# EAGLE schematic BMS-HVver2.0 (EAGLE 7.6.0) (continued)
## Parts (continued)
Q19  BSS308PE  BSS308PEBSS308PE  [SOT23]
Q20  BSS308PE  BSS308PEBSS308PE  [SOT23]
Q21  BSS308PE  BSS308PEBSS308PE  [SOT23]
Q22  BSS308PE  BSS308PEBSS308PE  [SOT23]
Q23  BSS308PE  BSS308PEBSS308PE  [SOT23]
Q24  BSS308PE  BSS308PEBSS308PE  [SOT23]
Q25  BSS308PE  BSS308PEBSS308PE  [SOT23]
Q26  BSS308PE  BSS308PEBSS308PE  [SOT23]
Q27  BSS308PE  BSS308PEBSS308PE  [SOT23]
Q28  BSS308PE  BSS308PEBSS308PE  [SOT23]
Q29  BSS308PE  BSS308PEBSS308PE  [SOT23]
Q30  BSS308PE  BSS308PEBSS308PE  [SOT23]
Q31  BSS308PE  BSS308PEBSS308PE  [SOT23]
Q32  BSS308PE  BSS308PEBSS308PE  [SOT23]
Q33  BSS308PE  BSS308PEBSS308PE  [SOT23]
Q34  BSS308PE  BSS308PEBSS308PE  [SOT23]
Q35  BSS308PE  BSS308PEBSS308PE  [SOT23]
Q36  BSS308PE  BSS308PEBSS308PE  [SOT23]
Q37  BSS308PE  BSS308PEBSS308PE  [SOT23]
Q38  BSS308PE  BSS308PEBSS308PE  [SOT23]
Q39  BSS308PE  BSS308PEBSS308PE  [SOT23]
R2  100  RES_100_1%  [0603]
R3  100  RES_100_1%  [0603]
R4  100  RES_100_1%  [0603]
R5  100  RES_100_1%  [0603]
R6  100  RES_100_1%  [0603]
R7  3.3K  RES_3.3K_5%  [0603]
R8  3.3K  RES_3.3K_5%  [0603]
R9  475  RES_475_1%  [0603]
R10  475  RES_475_1%  [0603]
R11  100  RES_100_1%  [0603]
R12  3.3K  RES_3.3K_5%  [0603]
R13  475  RES_475_1%  [0603]
R14  100  RES_100_1%  [0603]
R15  3.3K  RES_3.3K_5%  [0603]
R16  475  RES_475_1%  [0603]
R17  100  RES_100_1%  [0603]
R18  3.3K  RES_3.3K_5%  [0603]
R19  475  RES_475_1%  [0603]
R20  100  RES_100_1%  [0603]
R21  3.3K  RES_3.3K_5%  [0603]
R22  475  RES_475_1%  [0603]
R23  100  RES_100_1%  [0603]
R24  3.3K  RES_3.3K_5%  [0603]
R25  475  RES_475_1%  [0603]
R26  100  RES_100_1%  [0603]
R27  3.3K  RES_3.3K_5%  [0603]
R28  475  RES_475_1%  [0603]
R29  100  RES_100_1%  [0603]
R30  3.3K  RES_3.3K_5%  [0603]
R31  475  RES_475_1%  [0603]
R32  100  RES_100_0.1%_0805  [0805]
R33  3.3K  RES_3.3K_1%_0805  [0805]
R34  475  RES_475_1%  [0603]
R35  100  RES_100_1%  [0603]
R36  3.3K  RES_3.3K_5%  [0603]
R37  475  RES_475_1%  [0603]
R38  100  RES_100_0.1%_0805  [0805]
R39  3.3K  RES_3.3K_1%_0805  [0805]
R40  475  RES_475_1%  [0603]
R41  0  RES_0_0805  [0805]
R42  16  RES_16_5%_TH  [RR02J16RTB]
R43  16  RES_16_5%_TH  [RR02J16RTB]
R44  16  RES_16_5%_TH  [RR02J16RTB]
R45  16  RES_16_5%_TH  [RR02J16RTB]
R46  16  RES_16_5%_TH  [RR02J16RTB]
R47  16  RES_16_5%_TH  [RR02J16RTB]
R48  16  RES_16_5%_TH  [RR02J16RTB]
R49  16  RES_16_5%_TH  [RR02J16RTB]
R50  16  RES_16_5%_TH  [RR02J16RTB]
R51  16  RES_16_5%_TH  [RR02J16RTB]
R52  16  RES_16_5%_TH  [RR02J16RTB]
R53  16  RES_16_5%_TH  [RR02J16RTB]
R54  16  RES_16_5%_TH  [RR02J16RTB]
R55  16  RES_16_5%_TH  [RR02J16RTB]
R56  16  RES_16_5%_TH  [RR02J16RTB]
R57  16  RES_16_5%_TH  [RR02J16RTB]
R58  16  RES_16_5%_TH  [RR02J16RTB]
R59  16  RES_16_5%_TH  [RR02J16RTB]
R60  16  RES_16_5%_TH  [RR02J16RTB]
R61  16  RES_16_5%_TH  [RR02J16RTB]
R62  16  RES_16_5%_TH  [RR02J16RTB]
R63  16  RES_16_5%_TH  [RR02J16RTB]
R64  16  RES_16_5%_TH  [RR02J16RTB]
R65  16  RES_16_5%_TH  [RR02J16RTB]
R66  1K  RES_1K_5%  [0603]
R67  10K  RN-4_10K  [MNR14]
R68  100K  RES_100K_5%  [0603]
R69  1.2K  RES_1.2K_5%  [0603]
R70  787  RES_787_1%  [0805]
R71  10K-NTC  RES_10K_NTC  [NTC-NXRT15XH103FA5B]
R72  10K-NTC  RES_10K_NTC  [NTC-NXRT15XH103FA5B]
R73  10K-NTC  RES_10K_NTC  [NTC-NXRT15XH103FA5B]
R74  100  RES_100_1%  [0603]
R75  100  RES_100_0.1%_0805  [0805]
R76  100  RES_100_0.1%_0805  [0805]
R77  100  RES_100_1%  [0603]
R78  100  RES_100_1%  [0603]
R79  3.3K  RES_3.3K_1%_0805  [0805]
R80  3.3K  RES_3.3K_5%  [0603]
R81  475  RES_475_1%  [0603]
R82  475  RES_475_1%  [0603]
R83  100  RES_100_1%  [0603]
R84  3.3K  RES_3.3K_1%_0805  [0805]
R85  475  RES_475_1%  [0603]
R86  100  RES_100_1%  [0603]
R87  3.3K  RES_3.3K_5%  [0603]
R88  475  RES_475_1%  [0603]
R89  100  RES_100_1%  [0603]
R90  3.3K  RES_3.3K_5%  [0603]
R91  475  RES_475_1%  [0603]
R92  100  RES_100_1%  [0603]
R93  3.3K  RES_3.3K_5%  [0603]
R94  475  RES_475_1%  [0603]
R95  100  RES_100_1%  [0603]
R96  3.3K  RES_3.3K_5%  [0603]
R97  475  RES_475_1%  [0603]
R98  100  RES_100_1%  [0603]
R99  3.3K  RES_3.3K_5%  [0603]
R100  475  RES_475_1%  [0603]
R101  100  RES_100_1%  [0603]
R102  3.3K  RES_3.3K_5%  [0603]
R103  475  RES_475_1%  [0603]
R104  100  RES_100_0.1%_0805  [0805]
R105  3.3K  RES_3.3K_1%_0805  [0805]
R106  475  RES_475_1%  [0603]
R107  100  RES_100_1%  [0603]
R108  3.3K  RES_3.3K_5%  [0603]
R109  475  RES_475_1%  [0603]
R110  100  RES_100_1%  [0603]
R111  3.3K  RES_3.3K_5%  [0603]
R112  475  RES_475_1%  [0603]
R113  0  RES_0_1%  [0603]
R114  16  RES_16_5%_TH  [RR02J16RTB]
R115  16  RES_16_5%_TH  [RR02J16RTB]
R116  16  RES_16_5%_TH  [RR02J16RTB]
R117  16  RES_16_5%_TH  [RR02J16RTB]
R118  16  RES_16_5%_TH  [RR02J16RTB]
R119  16  RES_16_5%_TH  [RR02J16RTB]
R120  16  RES_16_5%_TH  [RR02J16RTB]
R121  16  RES_16_5%_TH  [RR02J16RTB]
R122  16  RES_16_5%_TH  [RR02J16RTB]
R123  16  RES_16_5%_TH  [RR02J16RTB]
R124  16  RES_16_5%_TH  [RR02J16RTB]
R125  16  RES_16_5%_TH  [RR02J16RTB]
R126  16  RES_16_5%_TH  [RR02J16RTB]
R127  16  RES_16_5%_TH  [RR02J16RTB]
R128  16  RES_16_5%_TH  [RR02J16RTB]
R129  16  RES_16_5%_TH  [RR02J16RTB]
R130  16  RES_16_5%_TH  [RR02J16RTB]
R131  16  RES_16_5%_TH  [RR02J16RTB]
R132  16  RES_16_5%_TH  [RR02J16RTB]
R133  16  RES_16_5%_TH  [RR02J16RTB]
R134  16  RES_16_5%_TH  [RR02J16RTB]
R135  16  RES_16_5%_TH  [RR02J16RTB]
R136  16  RES_16_5%_TH  [RR02J16RTB]
R137  16  RES_16_5%_TH  [RR02J16RTB]
R138  1K  RES_1K_5%  [0603]
R139  10K  RN-4_10K  [MNR14]
R140  100K  RES_100K_5%  [0603]
R141  1.2K  RES_1.2K_5%  [0603]
R142  787  RES_787_1%  [0805]
R143  10K-NTC  RES_10K_NTC  [NTC-NXRT15XH103FA5B]
R144  10K-NTC  RES_10K_NTC  [NTC-NXRT15XH103FA5B]
R145  10K-NTC  RES_10K_NTC  [NTC-NXRT15XH103FA5B]
R146  10K-NTC  RES_10K_NTC  [NTC-NXRT15XH103FA5B]
R147  10K-NTC  RES_10K_NTC  [NTC-NXRT15XH103FA5B]
R149  100  RES_100_1%  [0603]
R150  100  RES_100_1%  [0603]
R151  100  RES_100_1%  [0603]
R152  100  RES_100_1%  [0603]
R153  100  RES_100_0.1%_0805  [0805]
R154  3.3K  RES_3.3K_5%  [0603]
R155  3.3K  RES_3.3K_1%_0805  [0805]
R156  475  RES_475_1%  [0603]
R157  475  RES_475_1%  [0603]
R158  100  RES_100_1%  [0603]
R159  3.3K  RES_3.3K_5%  [0603]
R160  475  RES_475_1%  [0603]
R161  100  RES_100_1%  [0603]
R162  3.3K  RES_3.3K_1%_0805  [0805]
R163  475  RES_475_1%  [0603]
R164  100  RES_100_1%  [0603]
R165  3.3K  RES_3.3K_5%  [0603]
R166  475  RES_475_1%  [0603]
R167  100  RES_100_1%  [0603]
R168  3.3K  RES_3.3K_5%  [0603]
R169  475  RES_475_1%  [0603]
R170  100  RES_100_1%  [0603]
R171  3.3K  RES_3.3K_5%  [0603]
R172  475  RES_475_1%  [0603]
R173  100  RES_100_1%  [0603]
R174  3.3K  RES_3.3K_5%  [0603]
R175  475  RES_475_1%  [0603]
R176  100  RES_100_1%  [0603]
R177  3.3K  RES_3.3K_1%_0805  [0805]
R178  475  RES_475_1%  [0603]
R179  100  RES_100_1%  [0603]
R180  3.3K  RES_3.3K_5%  [0603]
R181  475  RES_475_1%  [0603]
R182  100  RES_100_0.1%_0805  [0805]
R183  3.3K  RES_3.3K_1%_0805  [0805]
R184  475  RES_475_1%  [0603]
R185  100  RES_100_1%  [0603]
R186  3.3K  RES_3.3K_1%_0805  [0805]
R187  475  RES_475_1%  [0603]
R188  0  RES_0_1%  [0603]
R189  16  RES_16_5%_TH  [RR02J16RTB]
R190  16  RES_16_5%_TH  [RR02J16RTB]
R191  16  RES_16_5%_TH  [RR02J16RTB]
R192  16  RES_16_5%_TH  [RR02J16RTB]
R193  16  RES_16_5%_TH  [RR02J16RTB]
R194  16  RES_16_5%_TH  [RR02J16RTB]
R195  16  RES_16_5%_TH  [RR02J16RTB]
R196  16  RES_16_5%_TH  [RR02J16RTB]
R197  16  RES_16_5%_TH  [RR02J16RTB]
R198  16  RES_16_5%_TH  [RR02J16RTB]
R199  16  RES_16_5%_TH  [RR02J16RTB]
R200  16  RES_16_5%_TH  [RR02J16RTB]
R201  16  RES_16_5%_TH  [RR02J16RTB]
R202  16  RES_16_5%_TH  [RR02J16RTB]
R203  16  RES_16_5%_TH  [RR02J16RTB]
R204  16  RES_16_5%_TH  [RR02J16RTB]
R205  16  RES_16_5%_TH  [RR02J16RTB]
R206  16  RES_16_5%_TH  [RR02J16RTB]
R207  16  RES_16_5%_TH  [RR02J16RTB]
R208  16  RES_16_5%_TH  [RR02J16RTB]
R209  16  RES_16_5%_TH  [RR02J16RTB]
R210  16  RES_16_5%_TH  [RR02J16RTB]
R211  16  RES_16_5%_TH  [RR02J16RTB]
R212  16  RES_16_5%_TH  [RR02J16RTB]
R213  1K  RES_1K_5%  [0603]
R214  10K  RN-4_10K  [MNR14]
R215  100K  RES_100K_5%  [0603]
R216  1.2K  RES_1.2K_5%  [0603]
R217  787  RES_787_1%  [0805]
R218  10K-NTC  RES_10K_NTC  [NTC-NXRT15XH103FA5B]
R219  10K-NTC  RES_10K_NTC  [NTC-NXRT15XH103FA5B]
R220  10K-NTC  RES_10K_NTC  [NTC-NXRT15XH103FA5B]
R221  10K-NTC  RES_10K_NTC  [NTC-NXRT15XH103FA5B]
SJ1  JUMPER-PAD-3-NOYES_SILK  [PAD-JUMPER-3-NO_YES_SILK]
SJ2  JUMPER-PAD-3-NOYES_SILK  [PAD-JUMPER-3-NO_YES_SILK]
SJ3  JUMPER-PAD-3-NOYES_SILK  [PAD-JUMPER-3-NO_YES_SILK]
SJ4  JUMPER-PAD-3-NOYES_SILK  [PAD-JUMPER-3-NO_YES_SILK]
SJ5  JUMPER-PAD-2-NOYES_SILK  [PAD-JUMPER-2-NO_YES_SILK]
SJ6  JUMPER-PAD-3-NOYES_SILK  [PAD-JUMPER-3-NO_YES_SILK]
SJ7  JUMPER-PAD-3-NOYES_SILK  [PAD-JUMPER-3-NO_YES_SILK]
SJ8  JUMPER-PAD-3-NOYES_SILK  [PAD-JUMPER-3-NO_YES_SILK]
SJ9  JUMPER-PAD-3-NOYES_SILK  [PAD-JUMPER-3-NO_YES_SILK]
SJ10  JUMPER-PAD-2-NOYES_SILK  [PAD-JUMPER-2-NO_YES_SILK]
SJ11  JUMPER-PAD-3-NOYES_SILK  [PAD-JUMPER-3-NO_YES_SILK]
SJ12  JUMPER-PAD-3-NOYES_SILK  [PAD-JUMPER-3-NO_YES_SILK]
SJ13  JUMPER-PAD-3-NOYES_SILK  [PAD-JUMPER-3-NO_YES_SILK]
SJ14  JUMPER-PAD-3-NOYES_SILK  [PAD-JUMPER-3-NO_YES_SILK]
SJ15  JUMPER-PAD-2-NOYES_SILK  [PAD-JUMPER-2-NO_YES_SILK]
TX1  PE-68386NLT  [PE-68386NLT]
TX2  PE-68386NLT  [PE-68386NLT]
TX3  PE-68386NLT  [PE-68386NLT]
U1  LTC6804-2  [SSOP-48]
U2  LTC6804-2  [SSOP-48]
U3  LTC6804-2  [SSOP-48]
U$1  POGOPIN  [POGOPIN]
U$2  POGOPIN  [POGOPIN]
U$3  POGOPIN  [POGOPIN]
U$4  POGOPIN  [POGOPIN]
U$5  POGOPIN  [POGOPIN]
U$6  POGOPIN  [POGOPIN]
U$7  POGOPIN  [POGOPIN]
U$8  POGOPIN  [POGOPIN]
U$9  POGOPIN  [POGOPIN]
U$10  POGOPIN  [POGOPIN]
U$11  POGOPIN  [POGOPIN]
U$12  POGOPIN  [POGOPIN]
U$13  POGOPIN  [POGOPIN]
U$14  POGOPIN  [POGOPIN]
U$15  POGOPIN  [POGOPIN]
U$16  POGOPIN  [POGOPIN]
U$17  POGOPIN  [POGOPIN]
U$18  POGOPIN  [POGOPIN]
U$19  POGOPIN  [POGOPIN]
U$20  POGOPIN  [POGOPIN]
U$21  POGOPIN  [POGOPIN]
U$22  POGOPIN  [POGOPIN]
U$23  POGOPIN  [POGOPIN]
U$24  POGOPIN  [POGOPIN]
U$25  POGOPIN  [POGOPIN]
U$26  POGOPIN  [POGOPIN]
U$27  LOGO16-2-L  [2016-2-LOGO-L]
U$28  NSV1C201MZ4T1G  [SOT223]
U$29  NSV1C201MZ4T1G  [SOT223]
U$30  NSV1C201MZ4T1G  [SOT223]
U$40  POGOPIN  [POGOPIN]
U$41  POGOPIN  [POGOPIN]
U$42  POGOPIN  [POGOPIN]
U$43  POGOPIN  [POGOPIN]
U$44  POGOPIN  [POGOPIN]
U$45  POGOPIN  [POGOPIN]
U$46  POGOPIN  [POGOPIN]
U$47  POGOPIN  [POGOPIN]
U$48  POGOPIN  [POGOPIN]
U$49  POGOPIN  [POGOPIN]
U$50  POGOPIN  [POGOPIN]
U$51  POGOPIN  [POGOPIN]
U$52  POGOPIN  [POGOPIN]

## Nets
A0: SJ9.2 U2.45(A0)
A1: SJ8.2 U2.46(A1)
A2: SJ7.2 U2.47(A2)
A3: SJ6.2 U2.48(A3)
A4: SJ4.2 U1.45(A0)
A5: SJ3.2 U1.46(A1)
A6: SJ2.2 U1.47(A2)
A7: SJ1.2 U1.48(A3)
A8: SJ14.2 U3.45(A0)
A9: SJ13.2 U3.46(A1)
A10: SJ12.2 U3.47(A2)
A11: SJ11.2 U3.48(A3)
C0: C55.2(-) C57.1(+) R110.2 U2.26(C0)
C1: C53.2(-) C55.1(+) R107.2 U2.24(C1)
C2: C51.2(-) C53.1(+) R104.2 U2.22(C2)
C3: C49.2(-) C51.1(+) R101.2 U2.20(C3)
C4: C47.2(-) C49.1(+) R98.2 U2.18(C4)
C5: C43.2(-) C47.1(+) R92.2 U2.16(C5)
C6: C43.1(+) C45.2(-) R95.2 U2.14(C6)
C7: C41.2(-) C45.1(+) R89.2 U2.12(C7)
C8: C39.2(-) C41.1(+) R86.2 U2.10(C8)
C9: C37.2(-) C39.1(+) R83.2 U2.8(C9)
C10: C34.2(-) C37.1(+) R77.2 U2.6(C10)
C11: C33.2(-) C34.1(+) R78.2 U2.4(C11)
C12: C33.1(+) R76.2 U2.2(C12)
C13: C3.1(+) R4.2 U1.2(C12)
C14: C3.2(-) C4.1(+) R6.2 U1.4(C11)
C15: C7.2(-) C9.1(+) R11.2 U1.8(C9)
C16: C11.2(-) C15.1(+) R17.2 U1.12(C7)
C17: C13.1(+) C15.2(-) R23.2 U1.14(C6)
C18: C13.2(-) C17.1(+) R20.2 U1.16(C5)
C19: C19.2(-) C23.1(+) R29.2 U1.20(C3)
C20: C23.2(-) C25.1(+) R32.2 U1.22(C2)
C21: C25.2(-) C27.1(+) R35.2 U1.24(C1)
C22: C4.2(-) C7.1(+) R5.2 U1.6(C10)
C23: C27.2(-) C29.1(+) R38.2 U1.26(C0)
C24: C17.2(-) C19.1(+) R26.2 U1.18(C4)
C25: C9.2(-) C11.1(+) R14.2 U1.10(C8)
C26: C65.1(+) R151.2 U3.2(C12)
C27: C65.2(-) C66.1(+) R153.2 U3.4(C11)
C28: C69.2(-) C71.1(+) R158.2 U3.8(C9)
C29: C73.2(-) C77.1(+) R164.2 U3.12(C7)
C30: C75.1(+) C77.2(-) R170.2 U3.14(C6)
C31: C75.2(-) C79.1(+) R167.2 U3.16(C5)
C32: C81.2(-) C83.1(+) R176.2 U3.20(C3)
C33: C83.2(-) C85.1(+) R179.2 U3.22(C2)
C34: C85.2(-) C87.1(+) R182.2 U3.24(C1)
C35: C66.2(-) C69.1(+) R152.2 U3.6(C10)
C36: C87.2(-) C89.1(+) R185.2 U3.26(C0)
C37: C79.2(-) C81.1(+) R173.2 U3.18(C4)
C38: C71.2(-) C73.1(+) R161.2 U3.10(C8)
DRIVE: U2.38(DRIVE) U$29.P$1
DRIVE1: U1.38(DRIVE) U$30.P$1
DRIVE2: U3.38(DRIVE) U$28.P$1
GND: C63.2(-) C64.2(-) C89.2(-) C90.2(-) C91.2(-) C92.2(-) C93.2(-) R188.2 R217.1 R218.P$1 R219.P$1 R220.P$1 R221.P$1 SJ11.3 SJ12.3 SJ13.3 SJ14.3 U3.30(V-*) U3.31(V-)
GNDA: C20.2(-) C21.2(-) C57.2(-) C58.2(-) C59.2(-) C60.2(-) C61.2(-) R113.2 R142.1 R143.P$1 R144.P$1 R145.P$1 R146.P$1 SJ6.3 SJ7.3 SJ8.3 SJ9.3 U2.30(V-*) U2.31(V-)
GNDI: C1.2(-) C2.2(-) C29.2(-) C30.2(-) C31.2(-) C32.2(-) R41.2 R70.1 R71.P$1 R72.P$1 R73.P$1 R147.P$1 SJ1.3 SJ2.3 SJ3.3 SJ4.3 U1.30(V-*) U1.31(V-)
GPIO1: R139.1 R143.P$2 U2.27(GPIO1)
GPIO2: R139.2 R144.P$2 U2.28(GPIO2)
GPIO3: R139.3 R145.P$2 U2.29(GPIO3)
GPIO4: R139.4 R146.P$2 U2.32(GPIO4)
GPIO5: R138.2 U2.33(GPIO5)
GPIO6: R67.2 R72.P$2 U1.28(GPIO2)
GPIO7: R67.1 R71.P$2 U1.27(GPIO1)
GPIO8: R67.4 R147.P$2 U1.32(GPIO4)
GPIO9: R67.3 R73.P$2 U1.29(GPIO3)
GPIO10: R66.2 U1.33(GPIO5)
GPIO11: R214.2 R219.P$2 U3.28(GPIO2)
GPIO12: R214.1 R218.P$2 U3.27(GPIO1)
GPIO13: R214.4 R221.P$2 U3.32(GPIO4)
GPIO14: R214.3 R220.P$2 U3.29(GPIO3)
GPIO15: R213.2 U3.33(GPIO5)
IBIAS: R141.2 U2.44(SDO_(IBIAS))
IBIAS1: R69.2 U1.44(SDO_(IBIAS))
IBIAS2: R216.2 U3.44(SDO_(IBIAS))
ICMP: R141.1 R142.2 U2.43(SDI_(ICMP))
ICMP1: R69.1 R70.2 U1.43(SDI_(ICMP))
ICMP2: R216.1 R217.2 U3.43(SDI_(ICMP))
IMA: TX1.3 U2.41(CSB_(IMA))
IMA1: TX2.3 U1.41(CSB_(IMA))
IMA2: TX3.3 U3.41(CSB_(IMA))
IPA: TX1.1 U2.42(SCK_(IPA))
IPA1: TX2.1 U1.42(SCK_(IPA))
IPA2: TX3.1 U3.42(SCK_(IPA))
N$1: Q12.1(G) R7.1
N$2: D1.A Q12.3(D) R64.P$2 R65.P$2
N$3: D1.C R9.2
N$4: F26.2 Q11.2(S) R6.1 R9.1 R64.P$1 R65.P$1
N$5: Q11.1(G) R8.1
N$6: D2.A Q11.3(D) R62.P$2 R63.P$2
N$7: D2.C R10.2
N$8: F27.2 Q10.2(S) R5.1 R10.1 R62.P$1 R63.P$1
N$9: Q10.1(G) R12.1
N$10: D3.A Q10.3(D) R60.P$2 R61.P$2
N$11: D3.C R13.2
N$12: F28.2 Q9.2(S) R11.1 R13.1 R60.P$1 R61.P$1
N$13: Q9.1(G) R15.1
N$14: D4.A Q9.3(D) R58.P$2 R59.P$2
N$15: D4.C R16.2
N$16: F29.2 Q8.2(S) R14.1 R16.1 R58.P$1 R59.P$1
N$17: Q8.1(G) R18.1
N$18: D5.A Q8.3(D) R56.P$2 R57.P$2
N$19: D5.C R19.2
N$20: Q6.1(G) R21.1
N$21: D6.A Q6.3(D) R52.P$2 R53.P$2
N$22: D6.C R22.2
N$23: F30.2 Q7.2(S) R17.1 R19.1 R56.P$1 R57.P$1
N$24: Q7.1(G) R24.1
N$25: D7.A Q7.3(D) R54.P$2 R55.P$2
N$26: D7.C R25.2
N$27: F31.2 Q6.2(S) R23.1 R25.1 R54.P$1 R55.P$1
N$28: F32.2 Q5.2(S) R20.1 R22.1 R52.P$1 R53.P$1
N$29: Q5.1(G) R27.1
N$30: D9.A Q5.3(D) R50.P$2 R51.P$2
N$31: D9.C R28.2
N$32: F33.2 Q4.2(S) R26.1 R28.1 R50.P$1 R51.P$1
N$33: Q4.1(G) R30.1
N$34: D10.A Q4.3(D) R48.P$2 R49.P$2
N$35: D10.C R31.2
N$36: F34.2 Q2.2(S) R29.1 R31.1 R48.P$1 R49.P$1
N$37: Q2.1(G) R33.1
N$38: D11.A Q2.3(D) R46.P$2 R47.P$2
N$39: D11.C R34.2
N$40: F35.2 Q1.2(S) R32.1 R34.1 R46.P$1 R47.P$1
N$41: Q1.1(G) R36.1
N$42: D12.A Q1.3(D) R44.P$2 R45.P$2
N$43: D12.C R37.2
N$44: Q3.1(G) R39.1
N$45: D13.C R40.2
N$46: F25.2 Q12.2(S) R2.1 R3.1 R4.1
N$47: D13.A Q3.3(D) R42.P$2 R43.P$2
N$48: R38.1 R40.1 R41.1 R42.P$1 R43.P$1 U$1.1(OUT)
N$49: F36.2 Q3.2(S) R35.1 R37.1 R44.P$1 R45.P$1
N$50: C2.1(+) R2.2 U$30.P$2
N$52: Q13.3(D) R67.5 R67.6 R67.7 R67.8
N$53: Q13.1(G) R66.1 R68.1
N$55: Q25.1(G) R154.1
N$56: D25.A Q25.3(D) R211.P$2 R212.P$2
N$57: D25.C R156.2
N$58: F2.2 Q24.2(S) R153.1 R156.1 R211.P$1 R212.P$1
N$59: Q24.1(G) R155.1
N$60: D26.A Q24.3(D) R209.P$2 R210.P$2
N$61: D26.C R157.2
N$62: F3.2 Q23.2(S) R152.1 R157.1 R209.P$1 R210.P$1
N$63: Q23.1(G) R159.1
N$64: D27.A Q23.3(D) R207.P$2 R208.P$2
N$65: D27.C R160.2
N$66: F4.2 Q22.2(S) R158.1 R160.1 R207.P$1 R208.P$1
N$67: Q22.1(G) R162.1
N$68: D28.A Q22.3(D) R205.P$2 R206.P$2
N$69: D28.C R163.2
N$70: F5.2 Q21.2(S) R161.1 R163.1 R205.P$1 R206.P$1
N$71: Q21.1(G) R165.1
N$72: D29.A Q21.3(D) R203.P$2 R204.P$2
N$73: D29.C R166.2
N$74: Q19.1(G) R168.1
N$75: D30.A Q19.3(D) R199.P$2 R200.P$2
N$76: D30.C R169.2
N$77: F6.2 Q20.2(S) R164.1 R166.1 R203.P$1 R204.P$1
N$78: Q20.1(G) R171.1
N$79: D31.A Q20.3(D) R201.P$2 R202.P$2
N$80: D31.C R172.2
N$81: F7.2 Q19.2(S) R170.1 R172.1 R201.P$1 R202.P$1
N$82: F8.2 Q18.2(S) R167.1 R169.1 R199.P$1 R200.P$1
N$83: Q18.1(G) R174.1
N$84: D32.A Q18.3(D) R197.P$2 R198.P$2
N$85: D32.C R175.2
N$86: F9.2 Q17.2(S) R173.1 R175.1 R197.P$1 R198.P$1
N$87: Q17.1(G) R177.1
N$88: D33.A Q17.3(D) R195.P$2 R196.P$2
N$89: D33.C R178.2
N$90: F10.2 Q15.2(S) R176.1 R178.1 R195.P$1 R196.P$1
N$91: Q15.1(G) R180.1
N$92: D34.A Q15.3(D) R193.P$2 R194.P$2
N$93: D34.C R181.2
N$94: F11.2 Q14.2(S) R179.1 R181.1 R193.P$1 R194.P$1
N$95: Q14.1(G) R183.1
N$96: D35.A Q14.3(D) R191.P$2 R192.P$2
N$97: D35.C R184.2
N$98: Q16.1(G) R186.1
N$99: D36.C R187.2
N$100: F1.2 Q25.2(S) R149.1 R150.1 R151.1
N$101: D36.A Q16.3(D) R189.P$2 R190.P$2
N$102: Q38.1(G) R79.1
N$103: D8.A Q38.3(D) R136.P$2 R137.P$2
N$104: D8.C R81.2
N$105: R185.1 R187.1 R188.1 R189.P$1 R190.P$1 U$14.1(OUT)
N$106: F12.2 Q16.2(S) R182.1 R184.1 R191.P$1 R192.P$1
N$107: C64.1(+) R149.2 U$28.P$2
N$108: F14.2 Q37.2(S) R78.1 R81.1 R136.P$1 R137.P$1
N$110: Q37.1(G) R80.1
N$111: D14.A Q37.3(D) R134.P$2 R135.P$2
N$112: D14.C R82.2
N$113: F15.2 Q36.2(S) R77.1 R82.1 R134.P$1 R135.P$1
N$114: Q26.3(D) R214.5 R214.6 R214.7 R214.8
N$115: Q36.1(G) R84.1
N$116: D15.A Q36.3(D) R132.P$2 R133.P$2
N$117: D15.C R85.2
N$118: F16.2 Q35.2(S) R83.1 R85.1 R132.P$1 R133.P$1
N$119: Q26.1(G) R213.1 R215.1
N$121: Q35.1(G) R87.1
N$122: D16.A Q35.3(D) R130.P$2 R131.P$2
N$123: D16.C R88.2
N$124: F17.2 Q34.2(S) R86.1 R88.1 R130.P$1 R131.P$1
N$125: J1.2 J2.1 TX1.6 TX2.6 TX3.6
N$126: Q34.1(G) R90.1
N$127: D17.A Q34.3(D) R128.P$2 R129.P$2
N$128: D17.C R91.2
N$129: J1.1 J2.2 TX1.4 TX2.4 TX3.4
N$130: Q32.1(G) R93.1
N$131: D18.A Q32.3(D) R124.P$2 R125.P$2
N$132: D18.C R94.2
N$133: C90.1(+) U3.35(VREF1)
N$134: F18.2 Q33.2(S) R89.1 R91.1 R128.P$1 R129.P$1
N$135: C30.1(+) U1.35(VREF1)
N$136: Q33.1(G) R96.1
N$137: D19.A Q33.3(D) R126.P$2 R127.P$2
N$138: D19.C R97.2
N$139: F19.2 Q32.2(S) R95.1 R97.1 R126.P$1 R127.P$1
N$142: F20.2 Q31.2(S) R92.1 R94.1 R124.P$1 R125.P$1
N$144: Q31.1(G) R99.1
N$145: D20.A Q31.3(D) R122.P$2 R123.P$2
N$146: D20.C R100.2
N$147: F21.2 Q30.2(S) R98.1 R100.1 R122.P$1 R123.P$1
N$149: Q30.1(G) R102.1
N$150: D21.A Q30.3(D) R120.P$2 R121.P$2
N$151: D21.C R103.2
N$152: F22.2 Q28.2(S) R101.1 R103.1 R120.P$1 R121.P$1
N$154: Q28.1(G) R105.1
N$155: D22.A Q28.3(D) R118.P$2 R119.P$2
N$156: D22.C R106.2
N$159: F23.2 Q27.2(S) R104.1 R106.1 R118.P$1 R119.P$1
N$161: Q27.1(G) R108.1
N$162: D23.A Q27.3(D) R116.P$2 R117.P$2
N$163: D23.C R109.2
N$165: Q29.1(G) R111.1
N$166: D24.C R112.2
N$170: F13.2 Q38.2(S) R74.1 R75.1 R76.1
N$175: D24.A Q29.3(D) R114.P$2 R115.P$2
N$176: R110.1 R112.1 R113.1 R114.P$1 R115.P$1 U$40.1(OUT)
N$177: F24.2 Q29.2(S) R107.1 R109.1 R116.P$1 R117.P$1
N$178: C21.1(+) R74.2 U$29.P$2
N$192: Q39.3(D) R139.5 R139.6 R139.7 R139.8
N$193: Q39.1(G) R138.1 R140.1
N$262: F12.1 U$15.1(OUT)
N$264: F11.1 U$16.1(OUT)
N$286: F10.1 U$17.1(OUT)
N$287: F9.1 U$18.1(OUT)
N$288: F8.1 U$19.1(OUT)
N$289: F7.1 U$20.1(OUT)
N$290: F6.1 U$21.1(OUT)
N$291: F5.1 U$22.1(OUT)
N$292: F4.1 U$23.1(OUT)
N$293: F3.1 U$24.1(OUT)
N$294: F2.1 U$25.1(OUT)
N$295: F1.1 U$26.1(OUT)
N$296: F24.1 U$41.1(OUT)
N$297: F23.1 U$42.1(OUT)
N$298: F22.1 U$43.1(OUT)
N$299: F21.1 U$44.1(OUT)
N$300: F20.1 U$45.1(OUT)
N$301: F19.1 U$46.1(OUT)
N$302: F18.1 U$47.1(OUT)
N$303: F17.1 U$48.1(OUT)
N$304: F16.1 U$49.1(OUT)
N$305: F15.1 U$50.1(OUT)
N$306: F14.1 U$51.1(OUT)
N$307: F13.1 U$52.1(OUT)
N$308: F36.1 U$2.1(OUT)
N$309: F35.1 U$3.1(OUT)
N$310: F34.1 U$4.1(OUT)
N$311: F33.1 U$5.1(OUT)
N$312: F32.1 U$6.1(OUT)
N$313: F31.1 U$7.1(OUT)
N$314: F30.1 U$8.1(OUT)
N$315: F29.1 U$9.1(OUT)
N$316: F28.1 U$10.1(OUT)
N$317: F27.1 U$11.1(OUT)
N$318: F26.1 U$12.1(OUT)
N$319: F25.1 U$13.1(OUT)
S1: R111.2 U2.25(S1)
S2: R108.2 U2.23(S2)
S3: R105.2 U2.21(S3)
S4: R102.2 U2.19(S4)
S5: R99.2 U2.17(S5)
S6: R93.2 U2.15(S6)
S7: R96.2 U2.13(S7)
S8: R90.2 U2.11(S8)
S9: R87.2 U2.9(S9)
S10: R84.2 U2.7(S10)
S11: R80.2 U2.5(S11)
S12: R79.2 U2.3(S12)
S13: R7.2 U1.3(S12)
S14: R8.2 U1.5(S11)
S15: R12.2 U1.7(S10)
S16: R15.2 U1.9(S9)
S17: R18.2 U1.11(S8)
S18: R21.2 U1.15(S6)
S19: R24.2 U1.13(S7)
S20: R27.2 U1.17(S5)
S21: R30.2 U1.19(S4)
S22: R33.2 U1.21(S3)
S23: R36.2 U1.23(S2)
S24: R39.2 U1.25(S1)
S25: R154.2 U3.3(S12)
S26: R155.2 U3.5(S11)
S27: R159.2 U3.7(S10)
S28: R162.2 U3.9(S9)
S29: R165.2 U3.11(S8)
S30: R168.2 U3.15(S6)
S31: R171.2 U3.13(S7)
S32: R174.2 U3.17(S5)
S33: R177.2 U3.19(S4)
S34: R180.2 U3.21(S3)
S35: R183.2 U3.23(S2)
S36: R186.2 U3.25(S1)
SWTEN: SJ10.1 U2.36(SWTEN)
SWTEN1: SJ5.1 U1.36(SWTEN)
SWTEN2: SJ15.1 U3.36(SWTEN)
V+: C20.1(+) R75.2 U2.1(V+)
V+1: C1.1(+) R3.2 U1.1(V+)
V+2: C63.1(+) R150.2 U3.1(V+)
VREF1: C58.1(+) U2.35(VREF1)
VREF2: C59.1(+) Q39.2(S) R140.2 U2.34(VREF2)
VREF4: C31.1(+) Q13.2(S) R68.2 U1.34(VREF2)
VREF6: C91.1(+) Q26.2(S) R215.2 U3.34(VREF2)
VREG: C60.1(+) C61.1(+) SJ6.1 SJ7.1 SJ8.1 SJ9.1 SJ10.2 U2.37(VREG) U2.40(ISOMD) U$29.P$3
VREG1: C32.1(+) SJ1.1 SJ2.1 SJ3.1 SJ4.1 SJ5.2 U1.37(VREG) U1.40(ISOMD) U$30.P$3
VREG2: C92.1(+) C93.1(+) SJ11.1 SJ12.1 SJ13.1 SJ14.1 SJ15.2 U3.37(VREG) U3.40(ISOMD) U$28.P$3
Unconnected: U1.39(WDT) U2.39(WDT) U3.39(WDT)

## Notes on the sheet
- VREF2
- VREF2 | VREF2
- VREF2
- VREF2 | VREF2
- 1

## Library data of the parts
C1 C2 C20 C21 C63 C64 = FSAE Electric:CAP; PARTNO: CL21B104KCC5PNC
C3 C4 C7 C9 C11 C13 C15 C17 C19 C23 C25 C27 C29 C33 C34 C37 C39 C41 C43 C45 C47 C49 C51 C53 C55 C57 C65 C66 C69 C71 C73 C75 C77 C79 C81 C83 C85 C87 C89 = FSAE Electric:CAP; PARTNO: CL10B103KC8NNNC
C30-C32 C58-C61 C90-C93 = FSAE Electric:CAP; PARTNO: UMK212F105ZG-T
D1-D36 = FSAE Electric:LED; PARTNO: LH R974-LP-1
F1-F36 = FSAE Electric:FUSE; PARTNO: C2Q 750
J1 J2 = FSAE Electric:M2; PARTNO: DF13-2P-1.25DS(20)
Q1-Q39 = FSAE Electric:BSS308PE: P-Ch Mosfet 30V 2A View on DigiKey <http://www.digikey.com/product-detail/en/BSS308PE%20H6327/BSS308PE%20H6327CT-ND/3196649>; PARTNO: BSS308PE H6327
R2-R6 R11 R14 R17 R20 R23 R26 R29 R35 R74 R77 R78 R83 R86 R89 R92 R95 R98 R101 R107 R110 R149-R152 R158 R161 R164 R167 R170 R173 R176 R179 R185 = FSAE Electric:RES: Resistors; PARTNO: RC0603FR-07100RL
R7 R8 R12 R15 R18 R21 R24 R27 R30 R36 R80 R87 R90 R93 R96 R99 R102 R108 R111 R154 R159 R165 R168 R171 R174 R180 = FSAE Electric:RES: Resistors; PARTNO: RC0603JR-073K3L
R9 R10 R13 R16 R19 R22 R25 R28 R31 R34 R37 R40 R81 R82 R85 R88 R91 R94 R97 R100 R103 R106 R109 R112 R156 R157 R160 R163 R166 R169 R172 R175 R178 R181 R184 R187 = FSAE Electric:RES: Resistors; PARTNO: CRCW0201475RFKED
R32 R38 R75 R76 R104 R153 R182 = FSAE Electric:RES: Resistors; PARTNO: RC0805FR-07100RL
R33 R39 R79 R84 R105 R155 R162 R177 R183 R186 = FSAE Electric:RES: Resistors; PARTNO: RC0805FR-073K3L
R41 = FSAE Electric:RES: Resistors; PARTNO: RC0805JR-070RL
R42-R65 R114-R137 R189-R212 = FSAE Electric:RES: Resistors; PARTNO: RR02J16RTB
R66 R138 R213 = FSAE Electric:RES: Resistors; PARTNO: RC0603JR-071KL
R67 R139 R214 = FSAE Electric:RN-4; PARTNO: MNR14ERAPJ103
R68 R140 R215 = FSAE Electric:RES: Resistors; PARTNO: RC0603JR-07100KL
R69 R141 R216 = FSAE Electric:RES: Resistors; PARTNO: RC0603JR-071K2L
R70 R142 R217 = FSAE Electric:RES: Resistors; PARTNO: RC0805FR-07787RL
R71-R73 R143-R147 R218-R221 = FSAE Electric:RES: Resistors; PARTNO: NXFT15XH103FA1B025
R113 R188 = FSAE Electric:RES: Resistors; PARTNO: CRCW06030000Z0EA
SJ1-SJ4 SJ6-SJ9 SJ11-SJ14 = SparkFun-Passives:JUMPER-PAD-3-NO
SJ5 SJ10 SJ15 = SparkFun-Passives:JUMPER-PAD-2-NO
TX1-TX3 = FSAE Electric:PE-68386NLT; PARTNO: PE-68386NLT
U1-U3 = FSAE Electric:LTC6804: The LTC6804 is a multicell battery stack monitor that measures up to 12 series connected battery cells with a total measurement error of less than 1.2mV. The cell measurement range of 0V to 5V makes the LTC6804 suitable for most battery chemistries. All 12 cell voltages can be captured in 290µs, and lower data acquisition rates can be selected for high noise reduction; PARTNO: LTC6804IG-2#PBF
U$1-U$26 U$40-U$52 = FSAE Electric:POGOPIN
U$27 = Pic:LOGO
U$28-U$30 = FSAE Electric:NSV1C201MZ4T1G; PARTNO: NSV1C201MZ4T1G